# EasyEDA Pro project Project_first.eprj, schematic Schematic2
Create Date: 2024-05-06; Page Name: 485_ERR; Project Name: Project_first; Schematic Name: Schematic2; Update Date: 2024-05-14; Company: 嘉立创EDA; Page Size: A4; Version: V1.0
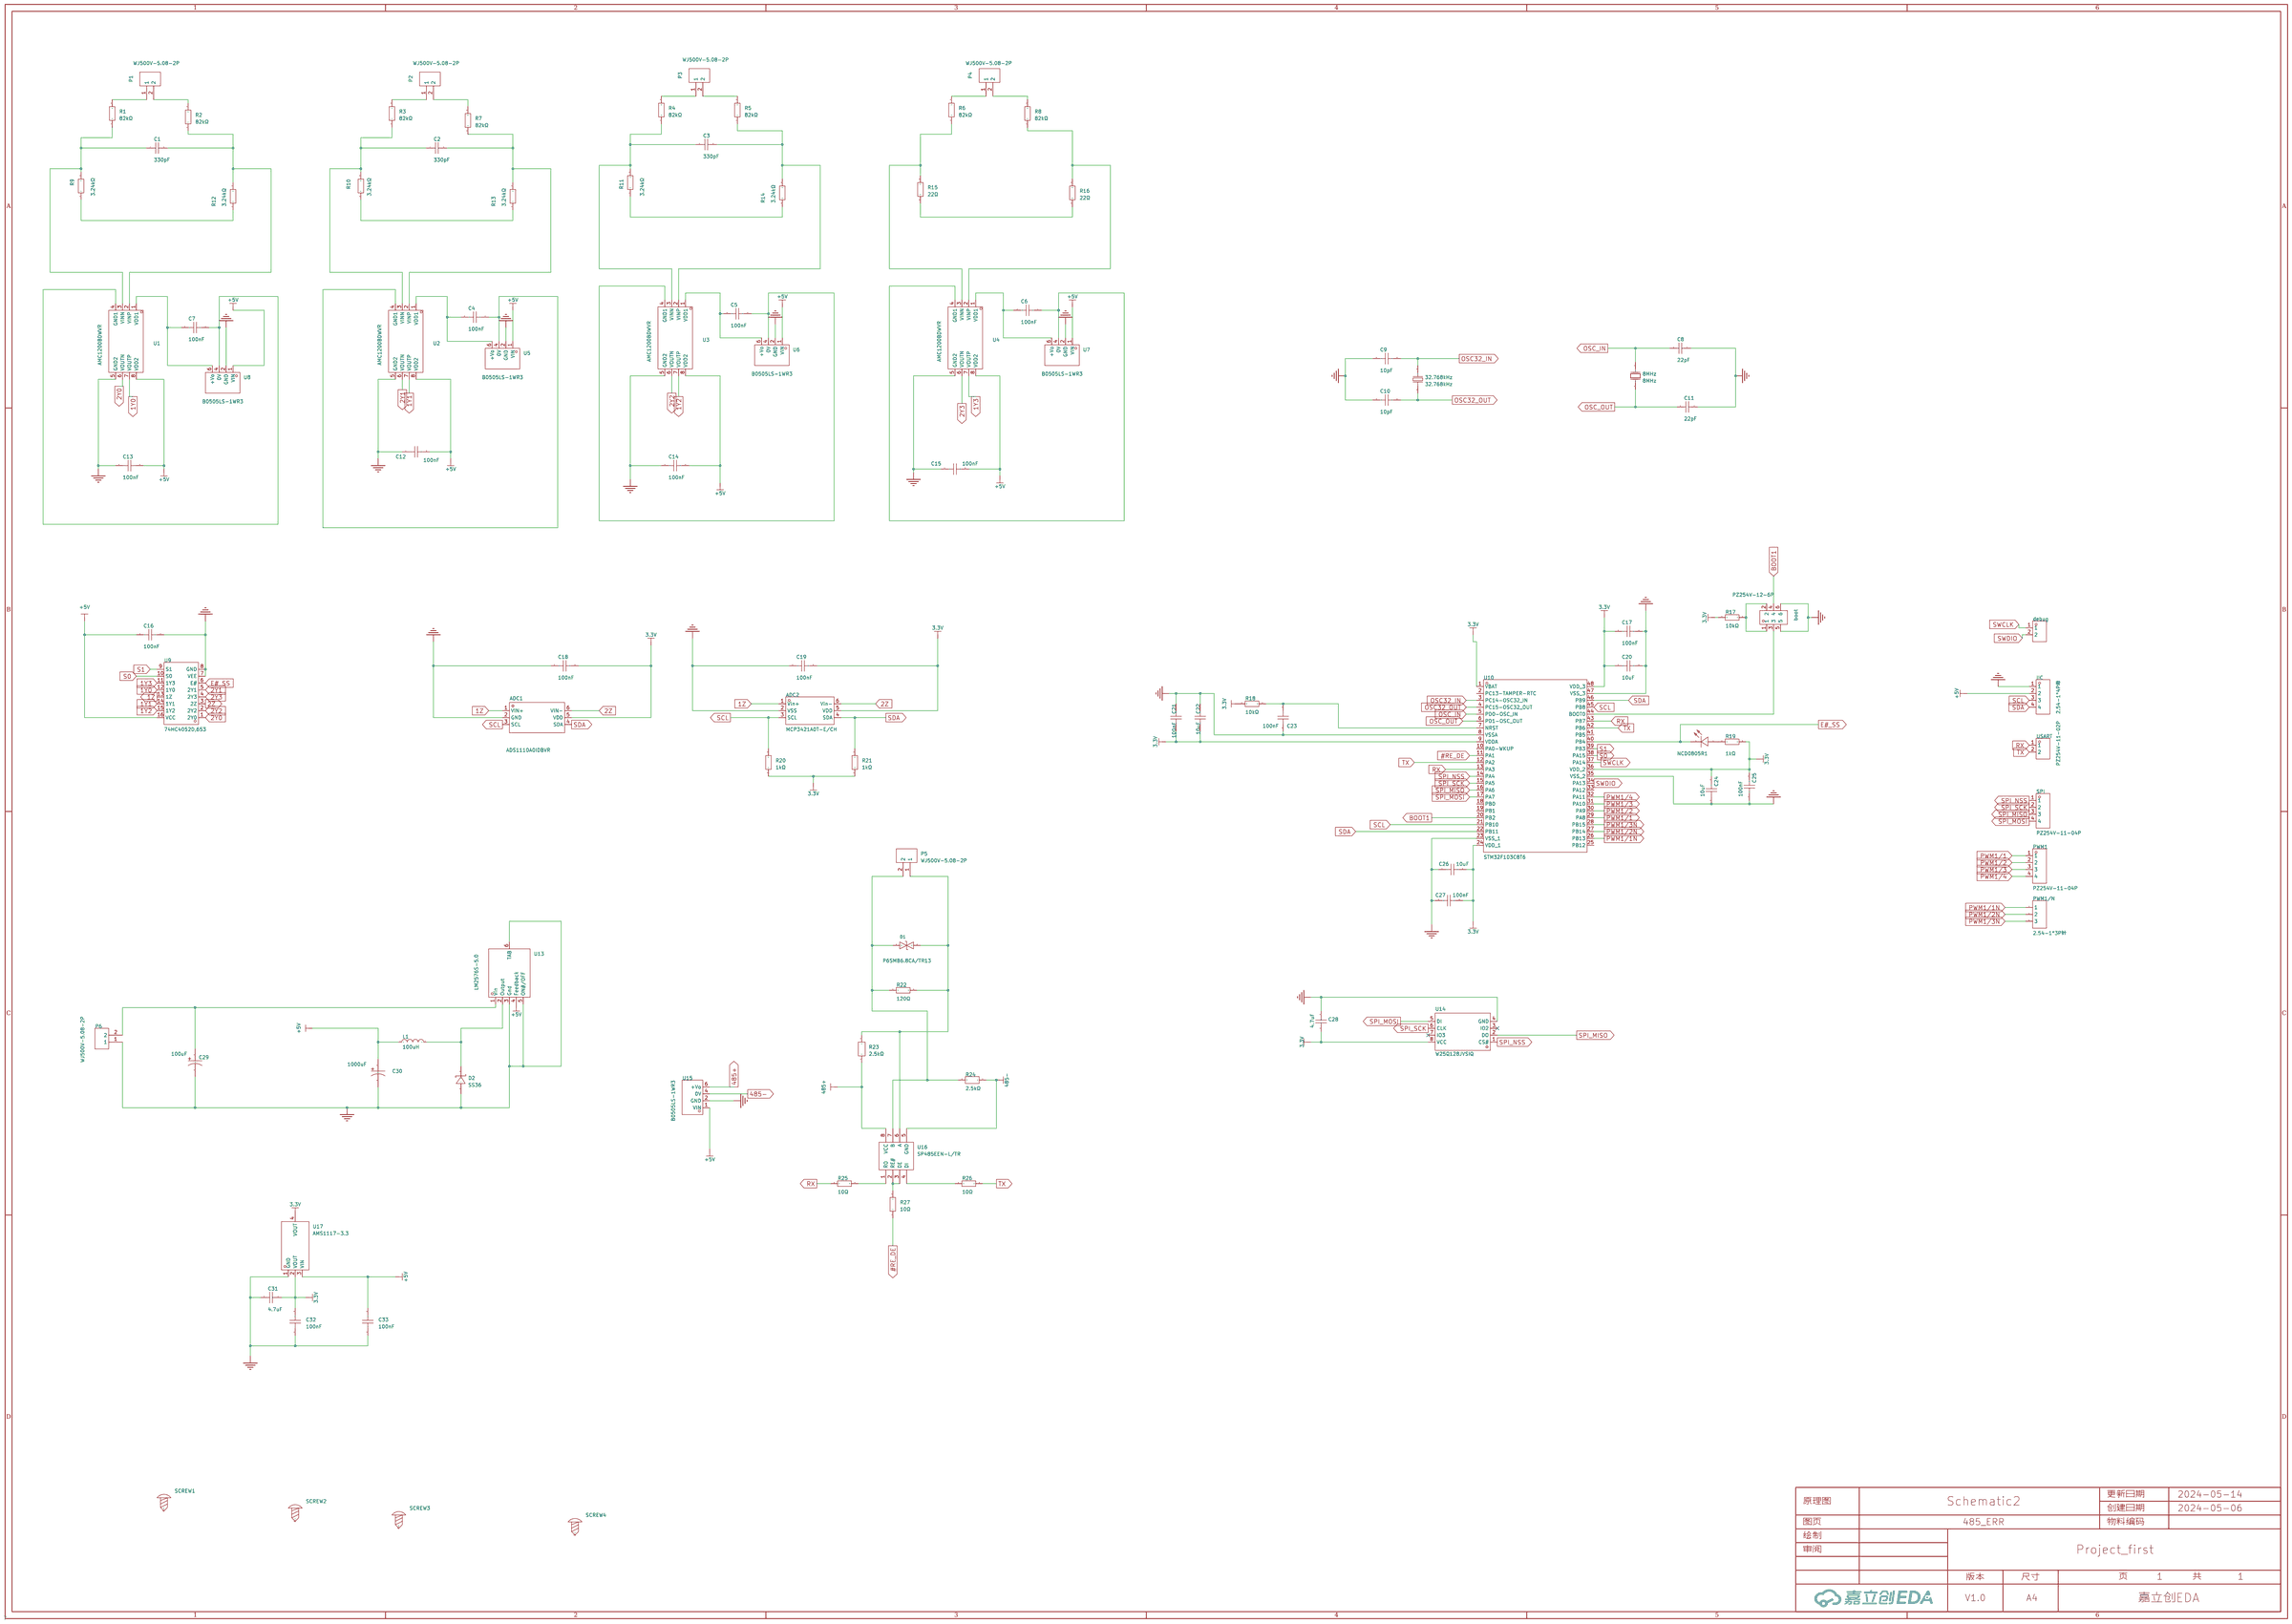
[diagram p1: schematic sheet]

## Parts
8MHz  8MHz  [OSC-TH_L10.0-W4.5-P5.00]
32.768kHz  32.768kHz  [FC-135R_L3.2-W1.5]
ADC1  ADS1110A0IDBVR  [SOT-23-6_L2.9-W1.6-P0.95-LS2.8-BR]
ADC2  MCP3421A0T-E/CH  [SOT-23-6_L2.9-W1.6-P0.95-LS2.8-BR]
boot  PZ254V-12-6P  [HDR-TH_6P-P2.54-V-M-R2-C3-S2.54]
C1  330pF  [C0603]
C2  330pF  [C0603]
C3  330pF  [C0603]
C4  100nF  [C0603]
C5  100nF  [C0603]
C6  100nF  [C0603]
C7  100nF  [C0603]
C8  22pF  [C0402]
C9  10pF  [C0402]
C10  10pF  [C0402]
C11  22pF  [C0402]
C12  100nF  [C0603]
C13  100nF  [C0603]
C14  100nF  [C0603]
C15  100nF  [C0603]
C16  100nF  [C0603]
C17  100nF  [C0603]
C18  100nF  [C0603]
C19  100nF  [C0603]
C20  10uF  [C0603]
C21  100nF  [C0603]
C22  10uF  [C0603]
C23  100nF  [C0603]
C24  10uF  [C0603]
C25  100nF  [C0603]
C26  10uF  [C0603]
C27  100nF  [C0603]
C28  4.7uF  [C0603]
C29  100uF  [CAP-TH_BD8.0-P3.50-D0.6-FD]
C30  1000uF  [CAP-TH_BD10.0-P5.00-D1.0-FD]
C31  4.7uF  [C0603]
C32  100nF  [C0603]
C33  100nF  [C0603]
D1  P6SMB6.8CA/TR13  [SMB_L4.6-W3.6-LS5.3-BI]
D2  SS36  [SMA_L4.4-W2.8-LS5.4-RD]
debug  PZ254V-11-02P  [HDR-TH_2P-P2.54-V-M]
IIC  2.54-1*4P母  [HDR-TH_4P-P2.54-V-F]
L1  100uH  [IND-SMD_L7.3-W7.3-1]
LED1  NCD0805R1  [LED0805-R-RD]
P1  WJ500V-5.08-2P  [CONN-TH_2P-P5.00_WJ500V-5.08-2P]
P2  WJ500V-5.08-2P  [CONN-TH_2P-P5.00_WJ500V-5.08-2P]
P3  WJ500V-5.08-2P  [CONN-TH_2P-P5.00_WJ500V-5.08-2P]
P4  WJ500V-5.08-2P  [CONN-TH_2P-P5.00_WJ500V-5.08-2P]
P5  WJ500V-5.08-2P  [CONN-TH_2P-P5.00_WJ500V-5.08-2P]
P6  WJ500V-5.08-2P  [CONN-TH_2P-P5.00_WJ500V-5.08-2P]
PWM1  PZ254V-11-04P  [HDR-TH_4P-P2.54-V-M]
PWM1/N  2.54-1*3P针  [HDR-TH_3P-P2.54-V-M-1]
R1  82kΩ  [R0603]
R2  82kΩ  [R0603]
R3  82kΩ  [R0603]
R4  82kΩ  [R0603]
R5  82kΩ  [R0603]
R6  82kΩ  [R0603]
R7  82kΩ  [R0603]
R8  82kΩ  [R0603]
R9  3.24kΩ  [R0603]
R10  3.24kΩ  [R0603]
R11  3.24kΩ  [R0603]
R12  3.24kΩ  [R0603]
R13  3.24kΩ  [R0603]
R14  3.24kΩ  [R0603]
R15  22Ω  [R0805]
R16  22Ω  [R0805]
R17  10kΩ  [R0805]
R18  10kΩ  [R0805]
R19  1kΩ  [R0805]
R20  1kΩ  [R0603]
R21  1kΩ  [R0603]
R22  120Ω  [R1206]
R23  2.5kΩ  [R0805]
R24  2.5kΩ  [R0805]
R25  10Ω  [R0402]
R26  10Ω  [R0402]
R27  10Ω  [R0402]
SCREW1  -  [M3螺丝]
SCREW2  -  [M3螺丝]
SCREW3  -  [M3螺丝]
SCREW4  -  [M3螺丝]
SPI  PZ254V-11-04P  [HDR-TH_4P-P2.54-V-M]
U1  AMC1200BDWVR  [SOIC-8_L5.9-W7.5-P1.27-LS11.5-BL]
U2  AMC1200BDWVR  [SOIC-8_L5.9-W7.5-P1.27-LS11.5-BL]
U3  AMC1200BDWVR  [SOIC-8_L5.9-W7.5-P1.27-LS11.5-BL]
U4  AMC1200BDWVR  [SOIC-8_L5.9-W7.5-P1.27-LS11.5-BL]
U5  B0505LS-1WR3  [PWRM-TH_BXXXXLS-1WR3]
U6  B0505LS-1WR3  [PWRM-TH_BXXXXLS-1WR3]
U7  B0505LS-1WR3  [PWRM-TH_BXXXXLS-1WR3]
U8  B0505LS-1WR3  [PWRM-TH_BXXXXLS-1WR3]
U9  74HC4052D,653  [SOIC-16_L9.9-W3.9-P1.27-LS6.0-BL]
U10  STM32F103C8T6  [LQFP-48_L7.0-W7.0-P0.50-LS9.0-BL]
U13  LM2576S-5.0  [TO-263-5_L10.2-W8.9-P1.70-BR]
U14  W25Q128JVSIQ  [SOIC-8_L5.3-W5.3-P1.27-LS8.0-BL]
U15  B0505LS-1WR3  [PWRM-TH_BXXXXLS-1WR3]
U16  SP485EEN-L/TR  [SOIC-8_L5.0-W4.0-P1.27-LS6.0-BL]
U17  AMS1117-3.3  [SOT-223-3_L6.5-W3.4-P2.30-LS7.0-BR]
USART  PZ254V-11-02P  [HDR-TH_2P-P2.54-V-M]

## Library data of the parts
8MHz = X49SD8MSD2SC: 晶振类型:直插晶振;频率:8MHz;常温频差:±20ppm;外接负载电容:20pF;频率稳定度(全温):±30ppm;; LCSC Part Name: 8MHz ±20ppm 20pF; Supplier Part: C21263; Manufacturer: YXC(扬兴晶振); Supplier Footprint: HC-49S; JLCPCB Part Class: Extended Part; Datasheet: https://atta.szlcsc.com/upload/public/pdf/source/20240329/977D7F2434F98B2BE33270BB9FF3D86D.pdf; Supplier: LCSC; Crystal Type: 直插晶振; Normal temperature Frequency Tolerance: ±20ppm; External load capacitor: 20pF; Frequency Stability(Full temperature range): ±30ppm; Operating Temperature: -20℃~+70℃
32.768kHz = Q13FC13500004_C32346: 晶振类型:贴片晶振;频率:32.768kHz;常温频差:±20ppm;外接负载电容:12.5pF;; LCSC Part Name: 32.768kHz ±20ppm 12.5pF; Supplier Part: C32346; Manufacturer: EPSON(爱普生); Manufacturer Part: Q13FC13500004; Supplier Footprint: SMD3215-2P; JLCPCB Part Class: Basic Part; Datasheet: https://atta.szlcsc.com/upload/public/pdf/source/20240418/0E0FF5F0356BA3753F616001439D1416.pdf; Supplier: LCSC; Crystal Type: 贴片晶振; Normal temperature Frequency Tolerance: ±20ppm; External load capacitor: 12.5pF; Equivalent Series Resistance (ESR): 70kΩ; Operating Temperature: -40℃~+85℃
ADC1 = ADS1110A0IDBVR: 接口:I2C;电源电压:2.7V~5.5V;采样率:240Hz;分辨率:16位;; Supplier Part: C16598; Manufacturer: TI(德州仪器); Supplier Footprint: SOT-23-6; JLCPCB Part Class: Extended Part; Datasheet: http://www.ti.com/cn/lit/gpn/ads1110; Supplier: LCSC; Interface: I2C; differential input: 是; number of channels: 1; Supply Voltage: 2.7V~5.5V; sampling frequency: 240Hz; resolution: 16位; Operating Temperature: -40℃~+125℃
ADC2 = MCP3421A0T-E/CH: 接口:I2C;电源电压:2.7V~5.5V;采样率:3.75Hz;分辨率:18位;; Supplier Part: C29454; Manufacturer: MICROCHIP(美国微芯); Supplier Footprint: SOT-23-6; JLCPCB Part Class: Extended Part; Datasheet: https://atta.szlcsc.com/upload/public/pdf/source/20140403/1457707041712.pdf; Supplier: LCSC; Interface: I2C; differential input: 是; number of channels: 1; Supply Voltage: 2.7V~5.5V; sampling frequency: 3.75Hz; resolution: 18位; Operating Temperature: -40℃~+125℃
boot = PZ254V-12-6P: 插针结构:2x3P;间距:2.54mm;行距:2.54mm;圆针/方针:方针;安装类型:直插;排数:双排;总PIN位数:6P;额定电流:-;额定电压:-;配合针长度:6mm;塑高:2.5mm;端接针长度:3mm;触头材质:黄铜;触头镀层:-;工作温度范围:-40℃~+105℃;颜色:黑色;; LCSC Part Name: 间距:2.54mm 2x3P 直插 方针; Supplier Part: C492420; Manufacturer: XFCN(兴飞); Supplier Footprint: 插件,P=2.54mm; JLCPCB Part Class: Extended Part; Datasheet: https://atta.szlcsc.com/upload/public/pdf/source/20200309/C492420_BAECB307B001054C09D200388220EAE6.pdf; Supplier: LCSC; Pin Structure: 2x3P; Pitch: 2.54mm; Row Spacing: 2.54mm; Circluar Pins/Square Pins: 方针; Mounting Type: 直插; Number of Rows: 双排; Number of Pins: 6P; Length of Mating Pin: 6mm; Insulation Height: 2.5mm; Length of End Connection Pin: 3mm; Contact Material: 黄铜; Operating Temperature Range: -40℃~+105℃; Color: 黑色
C1-C3 = CL10C331JB8NNNC: 容值:330pF;精度:±5%;额定电压:50V;材质(温度系数):C0G;; LCSC Part Name: 330pF ±5% 50V; Supplier Part: C1664; Manufacturer: SAMSUNG(三星); Supplier Footprint: 0603; JLCPCB Part Class: Basic Part; Datasheet: https://atta.szlcsc.com/upload/public/pdf/source/20160218/1457707763339.pdf; Supplier: LCSC; Tolerance: ±5%; Voltage Rated: 50V; Temperature Coefficient: C0G
C4-C7 C12-C19 C21 C23 C25 C27 C32 C33 = CC0603KRX7R9BB104: 容值:100nF;精度:±10%;额定电压:50V;材质(温度系数):X7R;; LCSC Part Name: 100nF ±10% 50V; Supplier Part: C14663; Manufacturer: YAGEO(国巨); Supplier Footprint: 0603; JLCPCB Part Class: Basic Part; Datasheet: https://atta.szlcsc.com/upload/public/pdf/source/20180910/C282072_33301C7F631E79921B82A8DAC6BCC5B3.pdf; Supplier: LCSC; Tolerance: ±10%; Voltage Rated: 50V; Temperature Coefficient: X7R
C8 C11 = 0402CG220J500NT: 容值:22pF;精度:±5%;额定电压:50V;材质(温度系数):C0G;; LCSC Part Name: 22pF ±5% 50V; Supplier Part: C1555; Manufacturer: FH(风华); Supplier Footprint: 0402; JLCPCB Part Class: Basic Part; Datasheet: https://atta.szlcsc.com/upload/public/pdf/source/20200305/C486355_26A10D38EF8C2A5C37091D0039909270.pdf; Supplier: LCSC; Tolerance: ±5%; Voltage Rated: 50V; Temperature Coefficient: C0G
C9 C10 = CL05C100JB5NNNC: 容值:10pF;精度:±5%;额定电压:50V;材质(温度系数):C0G;; LCSC Part Name: 10pF ±5% 50V; Supplier Part: C32949; Manufacturer: SAMSUNG(三星); Supplier Footprint: 0402; JLCPCB Part Class: Basic Part; Datasheet: https://atta.szlcsc.com/upload/public/pdf/source/20160218/1457707763339.pdf; Supplier: LCSC; Tolerance: ±5%; Voltage Rated: 50V; Temperature Coefficient: C0G
C20 C22 C24 C26 = CL10A106KP8NNNC: 容值:10uF;精度:±10%;额定电压:10V;材质(温度系数):X5R;; LCSC Part Name: 10uF ±10% 10V; Supplier Part: C19702; Manufacturer: SAMSUNG(三星); Supplier Footprint: 0603; JLCPCB Part Class: Basic Part; Datasheet: https://atta.szlcsc.com/upload/public/pdf/source/20160218/1457707763339.pdf; Supplier: LCSC; Tolerance: ±10%; Voltage Rated: 10V; Temperature Coefficient: X5R
C28 C31 = CL10A475KO8NNNC: 容值:4.7uF;精度:±10%;额定电压:16V;材质(温度系数):X5R;; LCSC Part Name: 4.7uF ±10% 16V; Supplier Part: C19666; Manufacturer: SAMSUNG(三星); Supplier Footprint: 0603; JLCPCB Part Class: Basic Part; Datasheet: https://atta.szlcsc.com/upload/public/pdf/source/20160218/1457707763339.pdf; Supplier: LCSC; Tolerance: ±10%; Voltage Rated: 16V; Temperature Coefficient: X5R
C29 = LKMD1401K101MF: 容值:100uF;精度:±20%;额定电压:80V;纹波电流:735mA@100kHz;等效串联电阻:210mΩ@100kHz;; LCSC Part Name: 100uF ±20% 80V; Supplier Part: C443069; Manufacturer: Ymin(永铭); Supplier Footprint: 插件,D8xL14mm; JLCPCB Part Class: Extended Part; Datasheet: https://atta.szlcsc.com/upload/public/pdf/source/20200220/C487520_443A40905984A455D375EE990FEAA9E8.pdf; Supplier: LCSC; Tolerance: ±20%; Rated Voltage: 80V; Ripple Current: 735mA@100kHz; Equivalent Series Resistance(ESR): 210mΩ@100kHz; Lead Spacing: 3.5mm; φD: 8mm; L: 14mm; Lifetime @ Temp: 10000hrs@105℃
C30 = RC025M102LO10*16TH-2A1E: 容值:1000uF;精度:±20%;额定电压:25V;纹波电流:1.45A@100kHz;; LCSC Part Name: 1000uF ±20% 25V; Supplier Part: C357640; Manufacturer: BERYL(绿宝石); Supplier Footprint: 插件,D10xL16mm; JLCPCB Part Class: Extended Part; Datasheet: https://atta.szlcsc.com/upload/public/pdf/source/20190116/C365813_D032970E50E497412ED095DEE828BCD0.pdf; Supplier: LCSC; Tolerance: ±20%; Rated Voltage: 25V; Ripple Current: 1.45A@100kHz; Lead Spacing: 5mm; φD: 10mm; L: 16mm; Lifetime @ Temp: 3000hrs@105℃; Operating Temperature: -40℃~+105℃
D1 = P6SMB6.8CA/TR13: 反向截止电压(Vrwm):5.8V;最大钳位电压:10.5V;峰值脉冲电流(Ipp)@10/1000us:58.1A;峰值脉冲功率(Ppp)@10/1000us:600W;击穿电压:6.45V;; Supplier Part: C78395; Manufacturer: Brightking(君耀电子); Supplier Footprint: SMB(DO-214AA); JLCPCB Part Class: Basic Part; Datasheet: https://atta.szlcsc.com/upload/public/pdf/source/20160709/1468031879762.pdf; Supplier: LCSC; Reverse Stand-Off Voltage (Vrwm): 5.8V; Maximum Clamping Voltage: 10.5V; Peak Pulse Current (Ipp)@10/1000us: 58.1A; Peak Pulse Power Dissipation (Ppp)@10/1000us: 600W; Breakdown Voltage: 6.45V; Type: TVS
D2 = SS36_C116712: 正向压降(Vf):700mV@3A;直流反向耐压(Vr):60V;平均整流电流(Io):3A;; LCSC Part Name: 电压:60V 电流:3A; Supplier Part: C116712; Manufacturer: 晶导微电子; Supplier Footprint: SMA(DO-214AC); JLCPCB Part Class: Extended Part; Datasheet: https://atta.szlcsc.com/upload/public/pdf/source/20170804/C123938_1501836222047866178.pdf; Supplier: LCSC; Forward Voltage (Vf@If): 700mV@3A; Reverse Voltage (Vr): 60V; Average Rectified Current (Io): 3A
debug USART = PZ254V-11-02P: 插针结构:1x2P;间距:2.54mm;行距:-;圆针/方针:方针;安装类型:直插;排数:单排;总PIN位数:2P;额定电流:-;额定电压:-;配合针长度:6mm;塑高:2.5mm;端接针长度:3mm;触头材质:黄铜;触头镀层:-;工作温度范围:-40℃~+105℃;颜色:黑色;; LCSC Part Name: 间距:2.54mm 1x2P 直插 方针; Supplier Part: C492401; Manufacturer: XFCN(兴飞); Supplier Footprint: 插件,P=2.54mm; JLCPCB Part Class: Extended Part; Datasheet: https://atta.szlcsc.com/upload/public/pdf/source/20200309/C492401_A812433581A9B211A7FFA413ADDFF0E5.pdf; Supplier: LCSC; Pin Structure: 1x2P; Pitch: 2.54mm; Circluar Pins/Square Pins: 方针; Mounting Type: 直插; Number of Rows: 单排; Number of Pins: 2P; Length of Mating Pin: 6mm; Insulation Height: 2.5mm; Length of End Connection Pin: 3mm; Contact Material: 黄铜; Operating Temperature Range: -40℃~+105℃; Color: 黑色
IIC = 2.54-1*4P母: 插孔结构:1x4P;间距:2.54mm;行距:-;圆孔/方孔:方孔;安装类型:直插;排数:单排;总孔位数:4P;额定电流:3A;额定电压:-;插孔方向:顶部;塑高:-;触头材质:青铜;触头镀层:-;工作温度范围:-40℃~+105℃;焊接温度(最大值):-;; LCSC Part Name: 间距:2.54mm 1x4P 直插; Supplier Part: C2718488; Manufacturer: BOOMELE(博穆精密); Supplier Footprint: 插件,P=2.54mm; JLCPCB Part Class: Extended Part; Datasheet: https://atta.szlcsc.com/upload/public/pdf/source/20210301/C2718488_F4427B881E42CAA8DDB0B1C12B3A522C.pdf; Supplier: LCSC; Holes Structure: 1x4P; Pitch: 2.54mm; Circular Hole / Square Hole: 方孔; Mounting Type: 直插; Number of Rows: 单排; Number of Holes: 4P; Current Rating (Max): 3A; Holes Direction: 顶部; Contact Material: 青铜; Operating Temperature Range: -40℃~+105℃
L1 = YPRH0704-101M: 电感值:100uH;精度:±20%;额定电流:600mA;; LCSC Part Name: 100uH ±20%; Supplier Part: C514812; Manufacturer: YJYCOIN(益嘉源); Supplier Footprint: SMD,7.3x7.3mm; JLCPCB Part Class: Extended Part; Datasheet: https://atta.szlcsc.com/upload/public/pdf/source/20200415/C514805_A0DEE7A5C2CBBD84C043B11E55CA01C7.pdf; Supplier: LCSC; Tolerance: ±20%; Rated Current: 600mA; DC Resistance (DCR): 610mΩ
LED1 = NCD0805R1: 灯头类型:-;发光颜色:红色;正向电压(VF):1.6V~2.6V;功率:65mW;正向电流:20mA;主波长:615nm~630nm;二极管配置:独立二极管;透镜颜色:无色透明透镜;色温:-;发光强度:67mcd~195mcd;发光角度:130°;载带方式:-;工作温度:-30℃~+85℃;; Supplier Part: C84256; Manufacturer: 国星光电; Supplier Footprint: 0805; JLCPCB Part Class: Basic Part; Datasheet: https://atta.szlcsc.com/upload/public/pdf/source/20200820/C84256_F0A75A43B3EAD75808600A0514C76B99.pdf; Supplier: LCSC; Emitted Color: 红色; Forward Voltage (VF): 1.6V~2.6V; Power Dissipation: 65mW; Forward Current: 20mA; Dominant Wavelength: 615nm~630nm; Diode Configuration: 独立二极管; Lens Color: 无色透明透镜; Luminous Intensity: 67mcd~195mcd; Viewing Angle: 130°; Operating Temperature: -30℃~+85℃
P1-P6 = WJ500V-5.08-2P: 结构:1x2P;间距:5.08mm;颜色:绿色;安装方式:直插;额定电流:18A;额定电压:250V;排数:1;线规 - AWG:14~30;线规 - 平方毫米:2.5;每排PIN数:2;触头材质:-;触头镀层:-;工作温度范围:-40℃~+105℃;焊接温度(最大值):-;; LCSC Part Name: 1x2P 5.08mm 直插 排数:1 每排P数:2; Supplier Part: C8465; Manufacturer: KANGNEX(康奈克斯电气); Supplier Footprint: 插件,P=5.08mm; JLCPCB Part Class: Extended Part; Datasheet: https://atta.szlcsc.com/upload/public/pdf/source/20191225/C8465_02D34CE5B5B4A53DF5891601D97FA9F4.pdf; Supplier: LCSC; Structure: 1x2P; Pitch: 5.08mm; Color: 绿色; Mounting Style: 直插; Current Rating (Max): 18A; Voltage Rating (Max): 250V; Number of Pins: 2P; Number of Rows: 1; Wire Gauge - AWG: 14~30; Wire Gauge - mm2: 2.5; Number of PINs Per Row: 2; Operating Temperature Range: -40℃~+105℃; Screw Specification: M2.5
PWM1 SPI = PZ254V-11-04P: 插针结构:1x4P;间距:2.54mm;行距:-;圆针/方针:方针;安装类型:直插;排数:单排;总PIN位数:4P;额定电流:3A;额定电压:250V;配合针长度:6mm;塑高:2.5mm;端接针长度:3mm;触头材质:-;工作温度范围:-40℃~+105℃;颜色:黑色;; LCSC Part Name: 间距:2.54mm 1x4P 直插 方针; Supplier Part: C2691448; Manufacturer: XFCN(兴飞); Supplier Footprint: 插件,P=2.54mm; JLCPCB Part Class: Extended Part; Datasheet: https://atta.szlcsc.com/upload/public/pdf/source/20200309/C492403_F9F19131791D08044AD4F84F8E751A34.pdf; Supplier: LCSC; Pin Structure: 1x4P; Pitch: 2.54mm; Circluar Pins/Square Pins: 方针; Mounting Type: 直插; Number of Rows: 单排; Number of Pins: 4P; Current Rating (Max): 3A; Voltage Rating (Max): 250V; Length of Mating Pin: 6mm; Insulation Height: 2.5mm; Length of End Connection Pin: 3mm; Operating Temperature Range: -40℃~+105℃; Color: 黑色
PWM1/N = 2.54-1*3P针: 插针结构:1x3P;间距:2.54mm;行距:-;圆针/方针:方针;安装类型:直插;排数:单排;总PIN位数:3P;额定电流:3A;额定电压:-;配合针长度:-;塑高:-;端接针长度:-;触头材质:-;触头镀层:-;工作温度范围:-40℃~+105℃;颜色:黑色;; LCSC Part Name: 间距:2.54mm 1x3P 直插 方针; Supplier Part: C49257; Manufacturer: BOOMELE(博穆精密); Supplier Footprint: 插件,P=2.54mm; JLCPCB Part Class: Extended Part; Datasheet: https://atta.szlcsc.com/upload/public/pdf/source/20221018/3E9408392E35E6F57A28985E5F7BF5C9.pdf; Supplier: LCSC; Pin Structure: 1x3P; Pitch: 2.54mm; Circluar Pins/Square Pins: 方针; Mounting Type: 直插; Number of Rows: 单排; Number of Pins: 3P; Current Rating (Max): 3A; Operating Temperature Range: -40℃~+105℃; Color: 黑色
R1-R8 = 0603WAF8202T5E: 电阻类型:厚膜电阻;阻值:82kΩ;精度:±1%;功率:100mW;最大工作电压:75V;温度系数:±100ppm/℃;; LCSC Part Name: 82kΩ ±1% 100mW 厚膜电阻; Supplier Part: C23254; Manufacturer: UNI-ROYAL(厚声); Supplier Footprint: 0603; JLCPCB Part Class: Basic Part; Datasheet: https://atta.szlcsc.com/upload/public/pdf/source/20200306/C422600_1E6D84923E4A46A82E41ADD87F860B5C.pdf; Supplier: LCSC; Type: 厚膜电阻; Tolerance: ±1%; Power(Watts): 100mW; Overload Voltage (Max): 75V; Temperature Coefficient: ±100ppm/℃; Operating Temperature Range: -55℃~+155℃
R9-R14 = 0603WAF3241T5E: 电阻类型:厚膜电阻;阻值:3.24kΩ;精度:±1%;功率:100mW;最大工作电压:75V;温度系数:±100ppm/℃;; LCSC Part Name: 3.24kΩ ±1% 100mW 厚膜电阻; Supplier Part: C22994; Manufacturer: UNI-ROYAL(厚声); Supplier Footprint: 0603; JLCPCB Part Class: Extended Part; Datasheet: https://atta.szlcsc.com/upload/public/pdf/source/20200306/C422600_1E6D84923E4A46A82E41ADD87F860B5C.pdf; Supplier: LCSC; Type: 厚膜电阻; Tolerance: ±1%; Power(Watts): 100mW; Overload Voltage (Max): 75V; Temperature Coefficient: ±100ppm/℃; Operating Temperature Range: -55℃~+155℃
R15 R16 = 0805W8F220JT5E: 电阻类型:厚膜电阻;阻值:22Ω;精度:±1%;功率:125mW;最大工作电压:150V;温度系数:±100ppm/℃;; LCSC Part Name: 22Ω ±1% 125mW 厚膜电阻; Supplier Part: C17561; Manufacturer: UNI-ROYAL(厚声); Supplier Footprint: 0805; JLCPCB Part Class: Basic Part; Datasheet: https://atta.szlcsc.com/upload/public/pdf/source/20200306/C422600_1E6D84923E4A46A82E41ADD87F860B5C.pdf; Supplier: LCSC; Type: 厚膜电阻; Tolerance: ±1%; Power(Watts): 125mW; Overload Voltage (Max): 150V; Temperature Coefficient: ±100ppm/℃; Operating Temperature Range: -55℃~+155℃
R17 R18 = 0805W8F1002T5E_C17414: 电阻类型:厚膜电阻;阻值:10kΩ;精度:±1%;功率:125mW;最大工作电压:150V;温度系数:±100ppm/℃;; LCSC Part Name: 10kΩ ±1% 125mW 厚膜电阻; Supplier Part: C17414; Manufacturer: UNI-ROYAL(厚声); Manufacturer Part: 0805W8F1002T5E; Supplier Footprint: 0805; JLCPCB Part Class: Basic Part; Datasheet: https://atta.szlcsc.com/upload/public/pdf/source/20200306/C422600_1E6D84923E4A46A82E41ADD87F860B5C.pdf; Supplier: LCSC; Type: 厚膜电阻; Tolerance: ±1%; Power(Watts): 125mW; Overload Voltage (Max): 150V; Temperature Coefficient: ±100ppm/℃; Operating Temperature Range: -55℃~+155℃
R19 = 0805W8F1001T5E: 电阻类型:厚膜电阻;阻值:1kΩ;精度:±1%;功率:125mW;最大工作电压:150V;温度系数:±100ppm/℃;; LCSC Part Name: 1kΩ ±1% 125mW 厚膜电阻; Supplier Part: C17513; Manufacturer: UNI-ROYAL(厚声); Supplier Footprint: 0805; JLCPCB Part Class: Basic Part; Datasheet: https://atta.szlcsc.com/upload/public/pdf/source/20200306/C422600_1E6D84923E4A46A82E41ADD87F860B5C.pdf; Supplier: LCSC; Type: 厚膜电阻; Tolerance: ±1%; Power(Watts): 125mW; Overload Voltage (Max): 150V; Temperature Coefficient: ±100ppm/℃; Operating Temperature Range: -55℃~+155℃
R20 R21 = 0603WAF1001T5E: 电阻类型:厚膜电阻;阻值:1kΩ;精度:±1%;功率:100mW;最大工作电压:75V;温度系数:±100ppm/℃;; LCSC Part Name: 1kΩ ±1% 100mW 厚膜电阻; Supplier Part: C21190; Manufacturer: UNI-ROYAL(厚声); Supplier Footprint: 0603; JLCPCB Part Class: Basic Part; Datasheet: https://atta.szlcsc.com/upload/public/pdf/source/20200306/C422600_1E6D84923E4A46A82E41ADD87F860B5C.pdf; Supplier: LCSC; Type: 厚膜电阻; Tolerance: ±1%; Power(Watts): 100mW; Overload Voltage (Max): 75V; Temperature Coefficient: ±100ppm/℃; Operating Temperature Range: -55℃~+155℃
R22 = 1206W4F1200T5E: 电阻类型:厚膜电阻;阻值:120Ω;精度:±1%;功率:250mW;最大工作电压:200V;温度系数:±100ppm/℃;; LCSC Part Name: 120Ω ±1% 250mW 厚膜电阻; Supplier Part: C17909; Manufacturer: UNI-ROYAL(厚声); Supplier Footprint: 1206; JLCPCB Part Class: Basic Part; Datasheet: https://atta.szlcsc.com/upload/public/pdf/source/20200306/C422600_1E6D84923E4A46A82E41ADD87F860B5C.pdf; Supplier: LCSC; Type: 厚膜电阻; Tolerance: ±1%; Power(Watts): 250mW; Overload Voltage (Max): 200V; Temperature Coefficient: ±100ppm/℃; Operating Temperature Range: -55℃~+155℃
R23 R24 = FRQ0805F2501TS: 电阻类型:厚膜电阻;阻值:2.5kΩ;精度:±1%;功率:125mW;最大工作电压:150V;温度系数:±100ppm/℃;; LCSC Part Name: 2.5kΩ ±1% 125mW 厚膜电阻; Supplier Part: C5713447; Manufacturer: FOJAN(富捷); Supplier Footprint: 0805; JLCPCB Part Class: Extended Part; Datasheet: https://atta.szlcsc.com/upload/public/pdf/source/20211221/925EC7D7225764EE0046F22065062C87.pdf; Supplier: LCSC; Type: 厚膜电阻; Tolerance: ±1%; Power(Watts): 125mW; Overload Voltage (Max): 150V; Temperature Coefficient: ±100ppm/℃
R25-R27 = 0402WGF100JTCE: 电阻类型:厚膜电阻;阻值:10Ω;精度:±1%;功率:62.5mW;最大工作电压:50V;温度系数:±200ppm/℃;; LCSC Part Name: 10Ω ±1% 62.5mW 厚膜电阻; Supplier Part: C25077; Manufacturer: UNI-ROYAL(厚声); Supplier Footprint: 0402; JLCPCB Part Class: Basic Part; Datasheet: https://atta.szlcsc.com/upload/public/pdf/source/20200306/C422600_1E6D84923E4A46A82E41ADD87F860B5C.pdf; Supplier: LCSC; Type: 厚膜电阻; Tolerance: ±1%; Power(Watts): 62.5mW; Overload Voltage (Max): 50V; Temperature Coefficient: ±200ppm/℃; Operating Temperature Range: -55℃~+155℃
SCREW1-SCREW4 = M3螺丝: Supplier Footprint: 插件
U1-U4 = AMC1200BDWVR: 放大器数:单路;-3dB带宽:100kHz;输入偏置电流(Ib):-;输入失调电压(Vos):200uV;; Supplier Part: C79905; Manufacturer: TI(德州仪器); Supplier Footprint: SOIC-8-300mil; JLCPCB Part Class: Extended Part; Datasheet: https://www.ti.com/cn/lit/gpn/amc1200; Supplier: LCSC; Number of Channels: 单路; Bandwidth (-3dB): 100kHz; Input Offset Voltage (Vos): 200uV; Operating Temperature: -40℃~+105℃
U5-U8 U15 = B0505LS-1WR3_C5365294: 输入电压(DC):4.5V~5.5V;输出电压:5V;输出功率:1W;输出电流(最大值):200mA;; LCSC Part Name: 直流隔离电源模块5V转5V短路保护; Supplier Part: C5365294; Manufacturer: HI-LINK(海凌科); Supplier Footprint: 插件; Supplier: LCSC; Input Voltage(DC): 4.5V~5.5V; Output Voltage: 5V; Output Power: 1W; Output Current (Max): 200mA; Isolation or not: 隔离; Insulated Voltage: 1.5kV; Feature: 短路保护
U9 = 74HC4052D,653: 开关电路:单刀四掷(SP4T);通道数:2;导通电阻(Ron@VCC):150Ω;; LCSC Part Name: 双4通道模拟复用器 解复用器; Supplier Part: C11350; Manufacturer: Nexperia(安世); Supplier Footprint: SOIC-16; JLCPCB Part Class: Extended Part; Datasheet: https://atta.szlcsc.com/upload/public/pdf/source/20130225/1457706594415.pdf; Supplier: LCSC; Switch Circuit: 单刀四掷(SP4T); Number of Channels: 2; Supply Voltage: 2V~10V; Turn-on time: 58ns; On-State Resistance (Max): 150Ω; Turn-off time: 48ns
U10 = STM32F103C8T6: CPU内核:CM3;程序存储容量:64KB;RAM总容量:20KB;GPIO端口数量:37;工作电压范围:2V~3.6V;CPU最大主频:72MHz;程序存储器类型:FLASH;; LCSC Part Name: STM32F103C8T6 MSL=3; Supplier Part: C8734; Manufacturer: ST(意法半导体); Supplier Footprint: LQFP-48(7x7); JLCPCB Part Class: Extended Part; Datasheet: https://atta.szlcsc.com/upload/public/pdf/source/20220812/8363ACEC51AD55ECEB84799464F7CB85.pdf; Supplier: LCSC; CPU Core: CM3; Program Storage Size: 64KB; RAM Size: 20KB; GPIO Ports Number: 37; Operating Voltage Range: 2V~3.6V; CPU Maximum Speed: 72MHz; Program Memory Type: FLASH; Operating Temperature Range: -40℃~+85℃; ADC (Bit): 12bit; Universal Serial Bus: 有; Peripheral/Function: 看门狗；DMA；看门狗；片载温度传感器; Watchdog: 有; Infrared Data Association: 有; Low-Voltage Detect: 有; Direct Memory Access: 有; Internal Oscillator: 有
U13 = LM2576S-5.0_C347413: 功能类型:降压型;输出类型:固定;输入电压:40V;输出电压:5V;输出电流(最大值):3A;; Supplier Part: C347413; Manufacturer: UMW(友台半导体); Supplier Footprint: TO-263-5; JLCPCB Part Class: Extended Part; Datasheet: https://atta.szlcsc.com/upload/public/pdf/source/20231109/97ACD99236AD6FA78302E85E1B8CCF74.pdf; Supplier: LCSC; Function: 降压型; Output Type: 固定; Input Voltage: 40V; Output Voltage: 5V; Output Current (Max): 3A; Switching Frequency: 52kHz; Operating Temperature: -40℃~+125℃@(TA); Synchronous Rectification: 是; Number of Outputs: 1; Topology: 降压式; Switch tube (built-in/external): 内置
U14 = W25Q128JVSIQ: 接口类型:-;存储容量:128Mbit;时钟频率(fc):-;; LCSC Part Name: W25Q128JVSIQ 编带; Supplier Part: C97521; Manufacturer: WINBOND(华邦); Supplier Footprint: SOIC-8-208mil; JLCPCB Part Class: Basic Part; Datasheet: https://atta.szlcsc.com/upload/public/pdf/source/20170316/1489627409956.pdf; Supplier: LCSC; Memory Size: 128Mbit
U16 = SP485EEN-L/TR: 类型:收发器;数据速率:10Mbps;驱动器/接收器:1/1;; LCSC Part Name: 增强型低功耗半双工RS-485收发器; Supplier Part: C6855; Manufacturer: MaxLinear(迈凌); Supplier Footprint: SOIC-8; JLCPCB Part Class: Basic Part; Datasheet: https://atta.szlcsc.com/upload/public/pdf/source/20210125/C916163_66C97B5ACCC910994E8B10780F9BD300.pdf; Supplier: LCSC; Types: 收发器; Supply Voltage: 4.75V~5.25V; Data Rate: 10Mbps; Driver/receiver: 1/1; Operating Temperature: -40℃~+85℃
U17 = AMS1117-3.3_C6186: 输出类型:固定;最大输入电压:-;输出电压:3.3V;最大输出电流:1A;电源纹波抑制比(PSRR):72dB@(120Hz);输出极性:正极;; LCSC Part Name: 输出3.3V 1A; Supplier Part: C6186; Manufacturer: AMS; Supplier Footprint: SOT-223-3; JLCPCB Part Class: Basic Part; Datasheet: https://atta.szlcsc.com/upload/public/pdf/source/20180727/C6186_7A095716F0823C02F1997A905E26C086.pdf; Supplier: LCSC; Output Type: 固定; Output Voltage: 3.3V; MAX Output Current: 1A; Power Supply Rejection Ratio (PSRR): 72dB@(120Hz); Dropout Voltage: 1.3V@(800mA); Output Polarity: 正极; Number of Outputs: 1

## Nets
3.3V: ADC1.5(VDD) ADC2.5(VDD) C17.1 C18.2 C19.2 C20.1 C21.1 C22.1 C24.2 C25.2 C26.2 C27.2 C28.1 C31.2 C32.2 R17.2 R18.1 R19.2 R20.1 R21.1 U10.1(VBAT) U10.9(VDDA) U10.24(VDD_1) U10.36(VDD_2) U10.48(VDD_3) U14.8(VCC) U17.2(VOUT) U17.4(VOUT)
+5V: C12.2 C13.2 C14.2 C15.2 C16.1 C30.1 C33.2 IIC.2 L1.1 U1.8(VDD2) U2.8(VDD2) U3.8(VDD2) U4.8(VDD2) U5.1(VIN) U6.1(VIN) U7.1(VIN) U8.1(VIN) U9.16(VCC) U13.4(Feedback) U15.1(VIN) U17.3(VIN)
GND: ADC1.2(GND) ADC2.2(VSS) boot.5 boot.6 C8.2 C9.1 C10.1 C11.2 C12.1 C13.1 C14.1 C15.1 C16.2 C17.2 C18.1 C19.1 C20.2 C21.2 C22.2 C23.2 C24.1 C25.1 C26.1 C27.1 C28.2 C29.2 C30.2 C31.1 C32.1 C33.1 D2.2(A) IIC.1 P6.1 U1.5(GND2) U2.5(GND2) U3.5(GND2) U4.5(GND2) U5.2(GND) U6.2(GND) U7.2(GND) U8.2(GND) U9.7(VEE) U9.8(GND) U10.8(VSSA) U10.23(VSS_1) U10.35(VSS_2) U10.47(VSS_3) U13.3(Gnd) U13.5(ON#/OFF) U13.6(TAB) U14.4(GND) U15.2(GND) U17.1(GND)
1Y0: U1.7(VOUTP) U9.12(1Y0)
1Y1: U2.7(VOUTP) U9.14(1Y1)
1Y2: U3.7(VOUTP) U9.15(1Y2)
1Y3: U4.7(VOUTP) U9.11(1Y3)
1Z: ADC1.1(VIN+) ADC2.1(Vin+) U9.13(1Z)
2Y0: U1.6(VOUTN) U9.1(2Y0)
2Y1: U2.6(VOUTN) U9.5(2Y1)
2Y2: U3.6(VOUTN) U9.2(2Y2)
2Y3: U4.6(VOUTN) U9.4(2Y3)
2Z: ADC1.6(VIN-) ADC2.6(Vin-) U9.3(2Z)
485+: R23.1 U15.6(+Vo) U16.8(VCC)
485-: R24.1 U15.4(0V) U16.5(GND)
#RE_DE: R27.1 U10.11(PA1)
BOOT1: boot.4 U10.20(PB2)
E#_SS: LED1.2(-) U9.6(E#) U10.40(PB4)
OSC32_IN: 32.768kHz.2 C9.2 U10.3(PC14-OSC32_IN)
OSC32_OUT: 32.768kHz.1 C10.2 U10.4(PC15-OSC32_OUT)
OSC_IN: 8MHz.1(OSC1) C8.1 U10.5(PD0-OSC_IN)
OSC_OUT: 8MHz.2(OSC2) C11.1 U10.6(PD1-OSC_OUT)
PWM1/1: PWM1.1 U10.29(PA8)
PWM1/1N: PWM1/N.1 U10.26(PB13)
PWM1/2: PWM1.2 U10.30(PA9)
PWM1/2N: PWM1/N.2 U10.27(PB14)
PWM1/3: PWM1.3 U10.31(PA10)
PWM1/3N: PWM1/N.3 U10.28(PB15)
PWM1/4: PWM1.4 U10.32(PA11)
RX: R25.1 U10.13(PA3) U10.43(PB7) USART.1
S0: U9.10(S0) U10.38(PA15)
S1: U9.9(S1) U10.39(PB3)
SCL: ADC1.3(SCL) ADC2.3(SCL) IIC.3 R20.2 U10.21(PB10) U10.45(PB8)
SDA: ADC1.4(SDA) ADC2.4(SDA) IIC.4 R21.2 U10.22(PB11) U10.46(PB9)
SPI_MISO: SPI.3 U10.16(PA6) U14.2(DO)
SPI_MOSI: SPI.4 U10.17(PA7) U14.5(DI)
SPI_NSS: SPI.1 U10.14(PA4) U14.1(CS#)
SPI_SCK: SPI.2 U10.15(PA5) U14.6(CLK)
SWCLK: debug.1 U10.37(PA14)
SWDIO: debug.2 U10.34(PA13)
TX: R26.2 U10.12(PA2) U10.42(PB6) USART.2
$1N240: P1.1 R1.2
$1N244: P1.2 R2.2
$1N367: R9.1 R12.1
$1N682: C1.1 R1.1 R9.2 U1.3(VINN)
$1N693: C1.2 R2.1 R12.2 U1.2(VINP)
$1N715: C7.2 U1.1(VDD1) U8.6(+Vo)
$1N2395: P2.1 R3.2
$1N2396: P2.2 R7.2
$1N2397: R10.1 R13.1
$1N2398: C2.1 R3.1 R10.2 U2.3(VINN)
$1N2399: C2.2 R7.1 R13.2 U2.2(VINP)
$1N2400: C4.2 U2.1(VDD1) U5.6(+Vo)
$1N2830: P3.1 R4.2
$1N2831: P3.2 R5.2
$1N2832: R11.1 R14.1
$1N2833: C3.1 R4.1 R11.2 U3.3(VINN)
$1N2834: C3.2 R5.1 R14.2 U3.2(VINP)
$1N2835: C5.2 U3.1(VDD1) U6.6(+Vo)
$1N3265: P4.1 R6.2
$1N3266: P4.2 R8.2
$1N3267: R15.1 R16.1
$1N3270: C6.2 U4.1(VDD1) U7.6(+Vo)
$1N4372: C29.1 P6.2 U13.1(Vin)
$1N4511: D2.1(K) L1.2 U13.2(Output)
$1N8375: boot.3 U10.44(BOOT0)
$1N8472: boot.1 boot.2 R17.1
$1N9302: C23.1 R18.2 U10.7(NRST)
$1N12640: R6.1 R15.2 U4.3(VINN)
$1N12690: R8.1 R16.2 U4.2(VINP)
$1N12902: R25.2 U16.1(RO)
$1N12946: R26.1 U16.4(DI)
$1N13621: R27.2 U16.2(RE#) U16.3(DE)
$1N14639: C7.1 U1.4(GND1) U8.4(0V)
$1N14648: C4.1 U2.4(GND1) U5.4(0V)
$1N14662: C6.1 U4.4(GND1) U7.4(0V)
$1N14671: C5.1 U3.4(GND1) U6.4(0V)
$1N21151: LED1.1(+) R19.1
$1N21203: D1.2 P5.2 R22.1 R24.2 U16.7(B)
$1N21228: D1.1 P5.1 R22.2 R23.2 U16.6(A)

Not connected (* = marked no-connect by the designer): SCREW1 1; SCREW2 1; SCREW3 1; SCREW4 1; U10 2(PC13-TAMPER-RTC) 10(PA0-WKUP) 18(PB0) 19(PB1) 25(PB12) 33(PA12) 41(PB5); U14 3(IO2)* 7(IO3)*
